# EasyEDA Pro project 智能视觉母版_2024.eprj, schematic Schematic1
Create Date: 2023-10-24; Page Name: P1; Project Name: 智能视觉母版_2024; Schematic Name: Schematic1; Update Date: 2023-11-27; Company: 嘉立创EDA; Page Size: A3; Version: V1.0
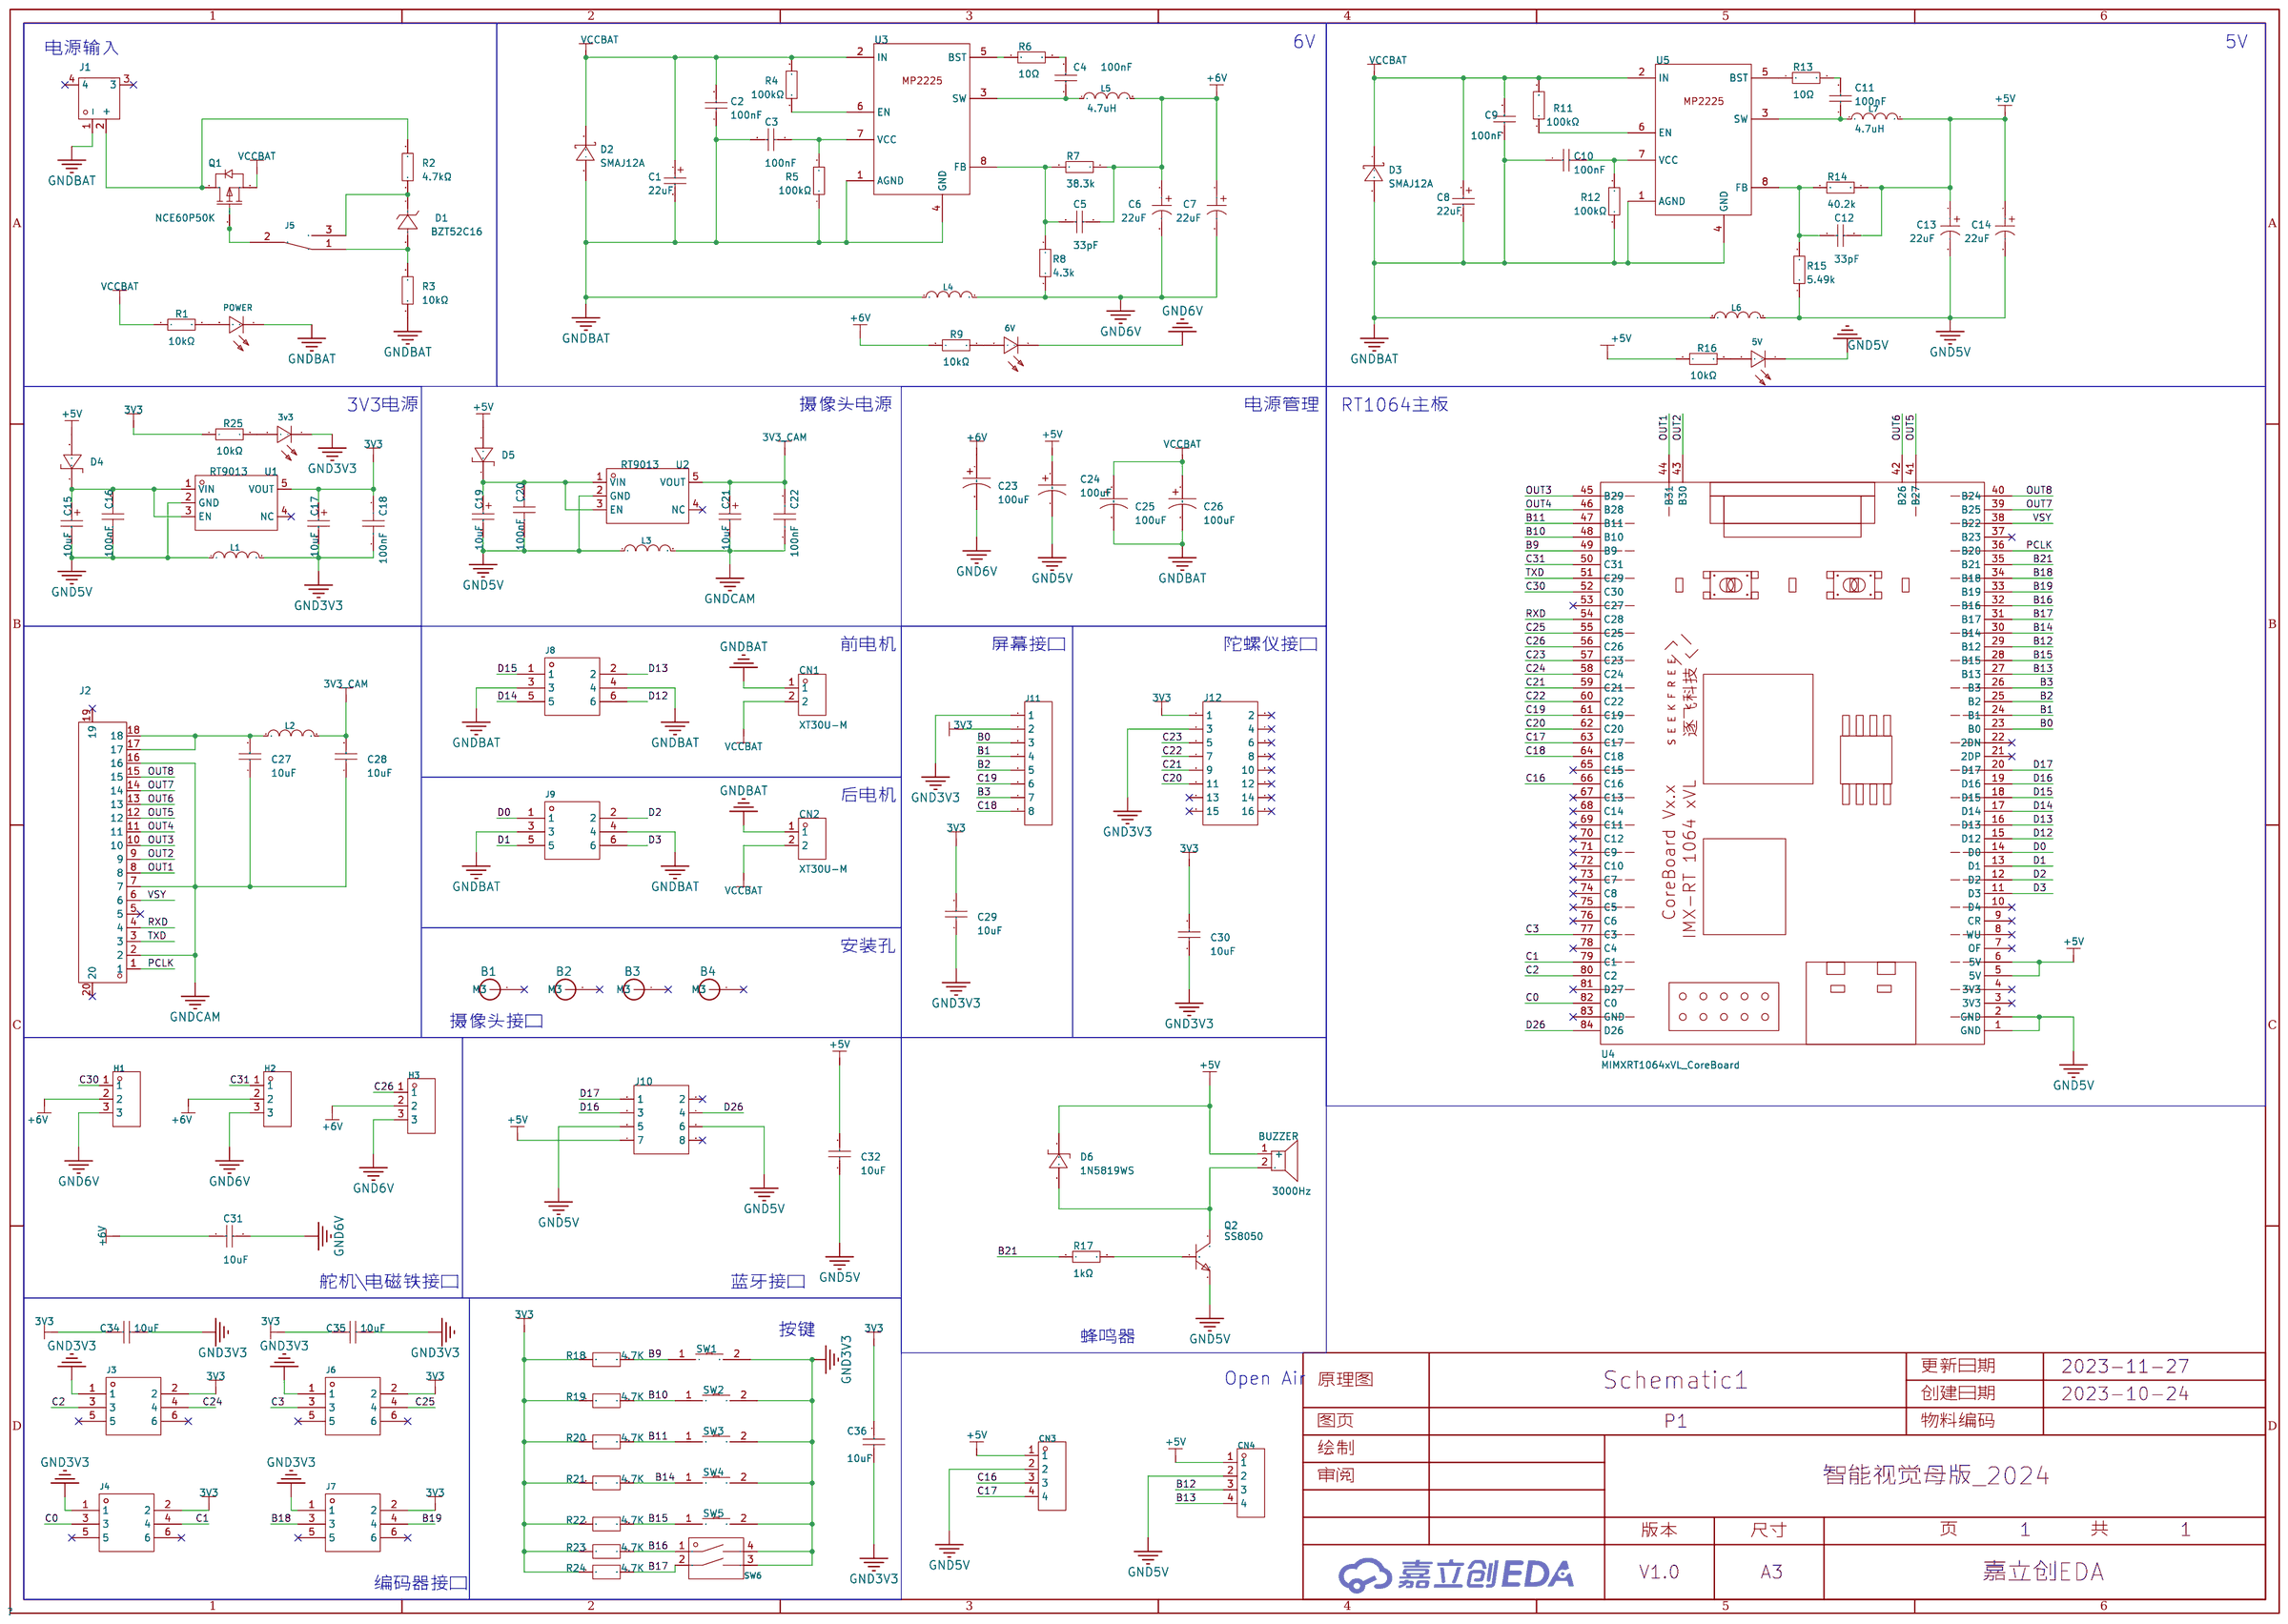
[diagram p0: schematic sheet]

## Parts
3v3  NCD0603W1  [LED0603-RD]
5V  NCD0603B1  [LED0603-RD]
6V  NCD0603W1  [LED0603-RD]
B1  M3螺柱孔_JX  [M3]
B2  M3螺柱孔_JX  [M3]
B3  M3螺柱孔_JX  [M3]
B4  M3螺柱孔_JX  [M3]
BUZZER  3000Hz  [BUZ-TH_BD9.6-P5.00-D0.7-FD]
C1  22uF  [CAP-SMD_L6.0-W3.2-R-RD]
C2  100nF  [C0603]
C3  100nF  [C0603]
C4  100nF  [C0603]
C5  33pF  [C0603]
C6  22uF  [CAP-SMD_L3.2-W1.6]
C7  22uF  [CAP-SMD_L3.2-W1.6]
C8  22uF  [CAP-SMD_L6.0-W3.2-R-RD]
C9  100nF  [C0603]
C10  100nF  [C0603]
C11  100nF  [C0603]
C12  33pF  [C0603]
C13  22uF  [CAP-SMD_L3.2-W1.6]
C14  22uF  [CAP-SMD_L3.2-W1.6]
C15  10uF  [CASE-A_3216]
C16  100nF  [C0603]
C17  10uF  [CASE-A_3216]
C18  100nF  [C0603]
C19  10uF  [CASE-A_3216]
C20  100nF  [C0603]
C21  10uF  [CASE-A_3216]
C22  100nF  [C0603]
C23  100uF  [CAP-TH_BD8.0-P3.50-D0.6-FD]
C24  100uF  [CAP-TH_BD8.0-P3.50-D0.6-FD]
C25  100uF  [CAP-TH_BD8.0-P3.50-D0.6-FD]
C26  100uF  [CAP-TH_BD8.0-P3.50-D0.6-FD]
C27  10uF  [C0805]
C28  10uF  [C0805]
C29  10uF  [C0805]
C30  10uF  [C0805]
C31  10uF  [C0805]
C32  10uF  [C0805]
C34  10uF  [C0805]
C35  10uF  [C0805]
C36  10uF  [C0805]
CN1  XT30U-M  [CONN-TH_XT30U-M]
CN2  XT30U-M  [CONN-TH_XT30U-M]
CN3  HC-XH-4A-G  [CONN-TH_4P-P2.50_HC-XH-4A-G]
CN4  HC-XH-4A-G  [CONN-TH_4P-P2.50_HC-XH-4A-G]
D1  BZT52C16  [SOD-123_L2.7-W1.6-LS3.7-RD]
D2  SMAJ12A  [SMA_L4.4-W2.7-LS5.1-RD]
D3  SMAJ12A  [SMA_L4.4-W2.7-LS5.1-RD]
D4  1N5819WS  [SOD-323_L1.8-W1.3-LS2.5-RD]
D5  1N5819WS  [SOD-323_L1.8-W1.3-LS2.5-RD]
D6  1N5819WS  [SOD-323_L1.8-W1.3-LS2.5-RD]
H1  -  [HDR-TH_3P-P2.54-V-F]
H2  -  [HDR-TH_3P-P2.54-V-F]
H3  -  [HDR-TH_3P-P2.54-V-F]
J1  XT60PW-M  [CONN-TH_XT60PW-M]
J2  0.5K-AX-18PWBG  [FPC-SMD_18P-P0.50_HDGC_0.5K-AX-18PWBG]
J3  75869-131LF  [CONN-TH_6P-P2.54_75869-131LF]
J4  75869-131LF  [CONN-TH_6P-P2.54_75869-131LF]
J5  MT-0-102-A101-M200-RS  [SW-TH_MT-0-103-A101-M200-RS]  (no BOM)
J6  75869-131LF  [CONN-TH_6P-P2.54_75869-131LF]
J7  75869-131LF  [CONN-TH_6P-P2.54_75869-131LF]
J8  75869-131LF  [CONN-TH_6P-P2.54_75869-131LF]
J9  75869-131LF  [CONN-TH_6P-P2.54_75869-131LF]
J10  -  [HDR-TH_8P-P2.54-V-F-R2-C4-S2.54-1]
J11  -  [HDR-TH_8P-P2.54-V-F-1]
J12  -  [HDR-TH_16P-P2.54-V-F-R2-C8-S2.54-1]
L1  CBG201209U000T  [L0805]
L2  CBG201209U000T  [L0805]
L3  CBG201209U000T  [L0805]
L4  CBG201209U000T  [L0805]
L5  4.7uH  [IND-SMD_L5.4-W5.2_FXL0530]
L6  CBG201209U000T  [L0805]
L7  4.7uH  [IND-SMD_L5.4-W5.2_FXL0530]
POWER  NCD0603R1  [LED0603-RD_RED]
Q1  NCE60P50K  [TO-252-2_L6.6-W6.1-P4.57-LS9.9-TL-CW]
Q2  SS8050  [SOT-23-3_L2.9-W1.3-P1.90-LS2.4-BR]
R1  10kΩ  [R0603]
R2  4.7kΩ  [R0603]
R3  10kΩ  [R0603]
R4  100kΩ  [R0603]
R5  100kΩ  [R0603]
R6  10Ω  [R0603]
R7  38.3k  [R0603]
R8  4.3k  [R0603]
R9  10kΩ  [R0603]
R11  100kΩ  [R0603]
R12  100kΩ  [R0603]
R13  10Ω  [R0603]
R14  40.2k  [R0603]
R15  5.49k  [R0603]
R16  10kΩ  [R0603]
R17  1kΩ  [R0603]
R18  4.7K  [R0603]
R19  4.7K  [R0603]
R20  4.7K  [R0603]
R21  4.7K  [R0603]
R22  4.7K  [R0603]
R23  4.7K  [R0603]
R24  4.7K  [R0603]
R25  10kΩ  [R0603]
SW1  TS-1101-C-W  [SW-SMD_L6.0-W3.3-LS8.0]
SW2  TS-1101-C-W  [SW-SMD_L6.0-W3.3-LS8.0]
SW3  TS-1101-C-W  [SW-SMD_L6.0-W3.3-LS8.0]
SW4  TS-1101-C-W  [SW-SMD_L6.0-W3.3-LS8.0]
SW5  TS-1101-C-W  [SW-SMD_L6.0-W3.3-LS8.0]
SW6  KF1001-02P-R0-FL-ON-01B  [SW-TH_KF1001-02P-R0-FL-ON-01B]
U1  RT9013  [SOT-23-5_L2.9-W1.6-P0.95-LS2.8-BR]
U2  RT9013  [SOT-23-5_L2.9-W1.6-P0.95-LS2.8-BR]
U3  -  [tsot-23-8_l2.9-w1.6-p0.65-ls2.8-br]
U4  MIMXRT1064xVL_CoreBoard  [MIMXRT1064xVL_CoreBoard - 3D]
U5  -  [tsot-23-8_l2.9-w1.6-p0.65-ls2.8-br]

## Library data of the parts
3v3 6V = NCD0603W1: 发光颜色:白灯;; LCSC Part Name: 白灯 0603白灯   正贴; Supplier Part: C84265; Manufacturer: 国星光电; Supplier Footprint: 0603; JLCPCB Part Class: Extended Part; Datasheet: https://atta.szlcsc.com/upload/public/pdf/source/20200820/C84265_479E6193713348A548E5CD6D9278BF16.pdf; Supplier: LCSC; Emitted Color: 白灯
5V = NCD0603B1: 发光颜色:蓝灯;; LCSC Part Name: 蓝灯; Supplier Part: C84266; Manufacturer: 国星光电; Supplier Footprint: 0603; JLCPCB Part Class: Extended Part; Datasheet: https://atta.szlcsc.com/upload/public/pdf/source/20200820/C84266_6A3CDBEFA72C6CAD68EDA53474ADAE6C.pdf; Supplier: LCSC; Emitted Color: 蓝灯
B1-B4 = M3螺柱孔_JX
BUZZER = HNB09A05: 驱动方式:有源(内含驱动线路);构造类型:电磁式;额定电压:5V;工作电压:4V~8V;频率:3000Hz;声压(SPL):85dB@5V,10cm;直径(φD):9mm;高度:5.7mm;; Supplier Part: C96493; Manufacturer: 华能; Supplier Footprint: 插件; JLCPCB Part Class: 扩展库; Datasheet: https://atta.szlcsc.com/upload/public/pdf/source/20170522/1495448327549.pdf; Supplier: LCSC; Oscillator Circuit: 有源(内含驱动线路); Technology Type: 电磁式; Rated Voltage: 5V; Operating Voltage: 4V~8V; Sound Pressure Level (SPL): 85dB@5V,10cm; Diameter (φD): 9mm; Height: 5.7mm
C1 C8 = TAJC226K025RNJ: 容值:22uF;精度:±10%;额定电压:25V;等效串联电阻:1.4Ω@100kHz;; LCSC Part Name: 22uF ±10% 25V; Supplier Part: C7214; Manufacturer: Kyocera AVX; Supplier Footprint: CASE-C-6032; JLCPCB Part Class: Extended Part; Datasheet: https://atta.szlcsc.com/upload/public/pdf/source/20160107/1457707749198.pdf; Supplier: LCSC; Tolerance: ±10%; Rated Voltage: 25V; Equivalent Series Resistance(ESR): 1.4Ω@100kHz; Operating Temperature: -55℃~+125℃
C2-C4 C9-C11 = 0603B104K500NT: 容值:100nF;精度:±10%;额定电压:50V;材质(温度系数):X7R;; LCSC Part Name: 100nF ±10% 50V; Supplier Part: C30926; Manufacturer: FH(风华); Supplier Footprint: 0603; JLCPCB Part Class: Extended Part; Datasheet: https://atta.szlcsc.com/upload/public/pdf/source/20170923/C30926_1506149436298988724.pdf; Supplier: LCSC; Tolerance: ±10%; Voltage Rated: 50V; Temperature Coefficient: X7R
C5 C12 = CL10C330JB8NNNC: 容值:33pF;精度:±5%;额定电压:50V;材质(温度系数):C0G;; LCSC Part Name: 33pF ±5% 50V; Supplier Part: C1663; Manufacturer: SAMSUNG(三星); Supplier Footprint: 0603; JLCPCB Part Class: 基础库; Datasheet: https://atta.szlcsc.com/upload/public/pdf/source/20160103/1457707688366.pdf; Supplier: LCSC; Tolerance: ±5%; Voltage Rated: 50V; Temperature Coefficient: C0G
C6 C7 C13 C14 = CA45-A-16V-22uF-K: 容值:22uF;精度:±10%;额定电压:16V;等效串联电阻:6Ω@100kHz;; LCSC Part Name: 22uF ±10% 16V; Supplier Part: C782264; Manufacturer: CEC(振华新云); Supplier Footprint: CASE-A-3216; JLCPCB Part Class: Extended Part; Datasheet: https://atta.szlcsc.com/upload/public/pdf/source/20200909/C782264_D6D9C4EF3B25E81633C26A9294FBB820.pdf; Supplier: LCSC; Tolerance: ±10%; Rated Voltage: 16V; Equivalent Series Resistance(ESR): 6Ω@100kHz; Operating Temperature: -55℃~+125℃
C15 C17 C19 C21 = CA45-A-10V-10uF-M: 容值:10uF;精度:±20%;额定电压:10V;等效串联电阻:8Ω@100kHz;工作温度:-55~+125;; LCSC Part Name: 10uF ±20% 10V; Supplier Part: C128256; Manufacturer: CEC(振华新云); JLCPCB Part Class: Extended Part; Datasheet: https://atta.szlcsc.com/upload/public/pdf/source/20171113/C128256_15105610660201115413.pdf; Supplier: LCSC; Tolerance: ±20%; Rated Voltage: 10V; Equivalent Series Resistance(ESR): 8Ω@100kHz; Operating Temperature: -55~+125
C16 C18 C20 C22 = CAP_0603: Supplier Footprint: 0603
C23-C26 = 25PZE220M8X9: 类型:混合物;容值:220uF;精度:±20%;额定电压:25V;电容体直径:8mm;电容体长度:9mm;脚间距:-;纹波电流:2.3A@100kHz;等效串联电阻:27mΩ@100kHz;工作寿命:10000hrs@105℃;工作温度:-55℃~+105℃;; LCSC Part Name: 220uF ±20% 25V; Supplier Part: C1578758; Manufacturer: rubycon(红宝石); Supplier Footprint: 径向引线,8x9mm; JLCPCB Part Class: Extended Part; Datasheet: https://atta.szlcsc.com/upload/public/pdf/source/20210510/C1578758_E2F1F56A0A42A1F170EC582F74BCA115.pdf; Supplier: LCSC; Type: 混合物; Tolerance: ±20%; Rated Voltage: 25V; φD: 8mm; L: 9mm; Ripple Current: 2.3A@100kHz; Equivalent Series Resistance(ESR): 27mΩ@100kHz; Lifetime @ Temp: 10000hrs@105℃; Operating Temperature: -55℃~+105℃
C27-C32 C34-C36 = CL21A106KAYNNNE_C15850: 容值:10uF;精度:±10%;额定电压:25V;材质(温度系数):X5R;; LCSC Part Name: 10uF ±10% 25V; Supplier Part: C15850; Manufacturer: SAMSUNG(三星); Manufacturer Part: CL21A106KAYNNNE; Supplier Footprint: 0805; JLCPCB Part Class: 基础库; Datasheet: https://atta.szlcsc.com/upload/public/pdf/source/20160103/1457707679302.pdf; Supplier: LCSC; Tolerance: ±10%; Voltage Rated: 25V; Temperature Coefficient: X5R
CN1 CN2 = XT30U-M: 模型插头轻量版锂电池插头; LCSC Part Name: AMASS(艾迈斯)轻量版锂电池插头公头 XT30U-M; Supplier Part: C99101; Manufacturer: AMASS(艾迈斯); JLCPCB Part Class: Extended Part; Datasheet: https://atta.szlcsc.com/upload/public/pdf/source/20170606/1496716542582.pdf; Supplier: LCSC
CN3 CN4 = HC-XH-4A-G: 参考系列:XH;间距:2.54mm;插针结构:1x4P;排数:1;每排PIN数:4;行距:2.54mm;公母:公型插针;安装方式:直插;额定电流:3A;工作温度范围:-25℃~+85℃;; LCSC Part Name: XH 2.54mm 1x4P 直插; Supplier Part: C5341203; Manufacturer: HCTL(华灿天禄); Supplier Footprint: 插件,P=2.5mm; JLCPCB Part Class: 扩展库; Datasheet: https://atta.szlcsc.com/upload/public/pdf/source/20230105/4FFD2EFD3DA44AA828171A44400F3EDE.pdf; Supplier: LCSC; Reference Series: XH; Pitch: 2.54mm; Pins Structure: 1x4P; Number of Rows: 1; Number of PINs Per Row: 4; Row Spacing: 2.54mm; Gender: 公型插针; Mounting Style: 直插; Current Rating (Max): 3A; Operating Temperature Range: -25℃~+85℃
D1 = BZT52C16: 稳压值(标称值):-;精度:-;功率:500mW;反向电流(Ir):100nA@11.2V;; LCSC Part Name: 500mW; Supplier Part: C707145; Manufacturer: Slkor(萨科微); Supplier Footprint: SOD-123; JLCPCB Part Class: 扩展库; Datasheet: https://atta.szlcsc.com/upload/public/pdf/source/20200721/C707125_BAEA70ACC1B0F60BBAC1FD71D8806D24.pdf; Supplier: LCSC; Power Dissipation: 500mW; Reverse Leakage Current (Ir): 100nA@11.2V
D2 D3 = SMAJ12A_C152123: 极性:单向;反向截止电压(Vrwm):12V;击穿电压:13.3V;峰值脉冲电流(Ipp)@10/1000μs:20.1A;最大钳位电压:19.9V;; LCSC Part Name: 单向 Vrwm:12V; Supplier Part: C152123; Manufacturer: BORN(伯恩半导体); Supplier Footprint: SMA(DO-214AC); JLCPCB Part Class: 扩展库; Datasheet: https://atta.szlcsc.com/upload/public/pdf/source/20181205/C152123_F062F647BF686681D55A64EEC7CBEC59.pdf; Supplier: LCSC; Polarity: 单向; Reverse Stand-Off Voltage (Vrwm): 12V; Breakdown Voltage: 13.3V; Peak Pulse Current (Ipp)@10/1000μs: 20.1A; Maximum Clamping Voltage: 19.9V
D4-D6 = 1N5819WS_C191023: 直流反向耐压(Vr):40V;平均整流电流(Io):1A;正向压降(Vf):600mV@1A;; LCSC Part Name: 40V 1A 600mV@1A; Supplier Part: C191023; Manufacturer: Hottech(合科泰); Supplier Footprint: SOD-323; JLCPCB Part Class: 基础库; Datasheet: https://atta.szlcsc.com/upload/public/pdf/source/20220428/3CB86FD8D28D653594B4E35F9D5AEFD9.pdf; Supplier: LCSC; Reverse Voltage (Vr): 40V; Average Rectified Current (Io): 1A; Forward Voltage (Vf@If): 600mV@1A
H1-H3 = HDR-F_2.54_1x3P: Supplier Part: C541850; Supplier Footprint: 插件
J1 = XT60PW-M: 模型锂电连接器; LCSC Part Name: AMASS(艾迈斯)航模插头xt90连接器150公母对接pw锂电池公头 板插卧式XT60PW-M; Supplier Part: C98732; Manufacturer: AMASS(艾迈斯); JLCPCB Part Class: 扩展库; Datasheet: https://atta.szlcsc.com/upload/public/pdf/source/20180125/C98732_15168617837851301983.pdf; Supplier: LCSC
J2 = 0.5K-AX-18PWBG: 间距:0.5mm;触点数量:18;锁定特性:抽屉式;安装类型:卧贴;触点类型:下接;工作温度范围:-20℃~+85℃;; LCSC Part Name: 0.5mm P数:18 抽屉式 下接; Supplier Part: C2911979; Manufacturer: HDGC(华德共创); Supplier Footprint: SMD,P=0.5mm; JLCPCB Part Class: 扩展库; Datasheet: https://atta.szlcsc.com/upload/public/pdf/source/20211029/35E053C67D57850EB47D55B58FB5F508.pdf; Supplier: LCSC; Pitch: 0.5mm; Number of Contacts: 18; Locking Feature: 抽屉式; Mounting Type: 卧贴; Contact Type: 下接; Height Above Board: 2mm; FFC, FCB Thickness: 0.3mm; Operating Temperature Range: -20℃~+85℃
J3 J4 J6-J9 = 75869-131LF: 参考系列:-;间距:2.54mm;插针结构:2x3P;排数:2;每排PIN数:3;行距:2.54mm;安装方式:-;触头材质:磷青铜;; LCSC Part Name: 2.54mm 2x3P; Supplier Part: C168680; Manufacturer: Amphenol; Supplier Footprint: 插件,P=2.54mm; JLCPCB Part Class: 扩展库; Supplier: LCSC; Pitch: 2.54mm; Pins Structure: 2x3P; Number of Rows: 2; Number of PINs Per Row: 3; Row Spacing: 2.54mm; Contact Material: 磷青铜
J5 = MT-0-102-A101-M200-RS: 额定电流:5A;额定电压(AC):125V;电路结构:单刀双掷;机械寿命:-;安装方式:直插;; LCSC Part Name: 小型钮子三脚二档 二件套 含配件; Supplier Part: C1788492; Manufacturer: YUEN FUNG(源丰); Supplier Footprint: 插件; JLCPCB Part Class: 扩展库; Datasheet: https://atta.szlcsc.com/upload/public/pdf/source/20230720/8E5C36EFDF374AE4FF4AC09DB233CE0E.pdf; Supplier: LCSC; Contact Current: 5A; Voltage Rating (AC): 125V; Circuit: 单刀双掷; Actuator Type: 圆柱钮柄; Pin Style: 焊片; Mounting Style: 直插; Operating Temperature: -25℃~+85℃; Switch Length: 13mm; Switch Width: 8mm; Switch Height: 28.6mm
J10 = HDR-F_2.54_2x4: Supplier Part: C92271; Supplier Footprint: 插件
J11 = HDR-F_2.54_1x8P: Supplier Part: C27438; Supplier Footprint: 插件
J12 = HDR-F_2.54_2x8: Supplier Part: C30734; Supplier Footprint: 插件
L1-L4 L6 = CBG201209U000T: 标称阻抗@测试频率:0Ω@100MHz;直流电阻(RDC):80mΩ;; LCSC Part Name: 单路 0805磁珠 阻抗0Ω@100MHz; Supplier Part: C91037; Manufacturer: FH(风华); Supplier Footprint: 0805; JLCPCB Part Class: 扩展库; Datasheet: https://atta.szlcsc.com/upload/public/pdf/source/20161217/1481939213023.pdf; Supplier: LCSC; Impedance @ Frequency: 0Ω@100MHz; DC Resistance: 80mΩ; Current Rating: 900mA; Circuits: 1
L5 L7 = FXL0530-4R7-M: 电感值:4.7uH;精度:±20%;额定电流:4.5A;饱和电流(Isat):5A;; LCSC Part Name: 4.7uH ±20% 4.5A 50mΩ; Supplier Part: C177246; Manufacturer: cjiang(长江微电); Supplier Footprint: SMD,5.4x5.2x2.8mm; JLCPCB Part Class: Extended Part; Supplier: LCSC; Tolerance: ±20%; Rated Current: 4.5A; Saturation Current (Isat): 5A; DC Resistance (DCR): 50mΩ
POWER = NCD0603R1_C84263: 发光颜色:红灯;; LCSC Part Name: 红灯 0603红灯   正贴; Supplier Part: C84263; Manufacturer: 国星光电; Supplier Footprint: 0603; JLCPCB Part Class: Extended Part; Datasheet: https://atta.szlcsc.com/upload/public/pdf/source/20200820/C84263_DABC6A75E58F576973B407FDBA283D60.pdf; Supplier: LCSC; Emitted Color: 红灯
Q1 = NCE60P50K: 类型:P沟道;漏源电压(Vdss):60V;连续漏极电流(Id):50A;功率(Pd):95W;导通电阻(RDS(on)@Vgs,Id):23mΩ@10V,20A;阈值电压(Vgs(th)@Id):3.5V@250uA;; LCSC Part Name: P沟道 60V 50A; Supplier Part: C130104; Manufacturer: NCE(无锡新洁能); Supplier Footprint: TO-252-2(DPAK); JLCPCB Part Class: 扩展库; Datasheet: https://atta.szlcsc.com/upload/public/pdf/source/20170919/C130104_1505787180031976877.pdf; Supplier: LCSC; Type: P沟道; Drain Source Voltage (Vdss): 60V; Continuous Drain Current (Id): 50A; Power Dissipation (Pd): 95W; Drain Source On Resistance (RDS(on)@Vgs,Id): 23mΩ@10V,20A; Gate Threshold Voltage (Vgs(th)@Id): 3.5V@250uA
Q2 = SS8050_C2150: 晶体管类型:NPN;集射极击穿电压(Vceo):25V;集电极电流(Ic):1.5A;功率(Pd):300mW;直流电流增益(hFE@Ic,Vce):200@100mA,1V;; LCSC Part Name: NPN 25V 1.5A Y1 200-350; Supplier Part: C2150; Manufacturer: CJ(江苏长电/长晶); Supplier Footprint: SOT-23; JLCPCB Part Class: 基础库; Datasheet: https://atta.szlcsc.com/upload/public/pdf/source/20230322/AEE86F4B043774EFF80CAEA14A37D9E9.pdf; Supplier: LCSC; Transistor Type: NPN; Collector-Emitter Breakdown Voltage (Vceo): 25V; Collector Current (Ic): 1.5A; Power Dissipation (Pd): 300mW; Collector Cut-Off Current (Icbo): 100nA; Collector-Emitter Saturation Voltage (VCE(sat)@Ic,Ib): 500mV@800mA,80mA; DC Current Gain (hFE@Ic,Vce): 200@100mA,1V; Transition Frequency (fT): 100MHz; Operating Temperature: +150℃@(Tj)
R1 R3 R9 R16 R25 = 0603WAF1002T5E: 电阻类型:厚膜电阻;阻值:10kΩ;精度:±1%;功率:100mW;; LCSC Part Name: 厚膜电阻 10kΩ ±1% 100mW; Supplier Part: C25804; Manufacturer: UNI-ROYAL(厚声); Supplier Footprint: 0603; JLCPCB Part Class: 基础库; Datasheet: https://atta.szlcsc.com/upload/public/pdf/source/20200306/C422600_1E6D84923E4A46A82E41ADD87F860B5C.pdf; Supplier: LCSC; Type: 厚膜电阻; Tolerance: ±1%; Power(Watts): 100mW; Temperature Coefficient: ±100ppm/℃; Overload Voltage (Max): 75V; Operating Temperature Range: -55℃~+155℃
R2 = 0603WAF4701T5E: 电阻类型:厚膜电阻;阻值:4.7kΩ;精度:±1%;功率:100mW;; LCSC Part Name: 4.7kΩ ±1% 100mW; Supplier Part: C23162; Manufacturer: UNI-ROYAL(厚声); Supplier Footprint: 0603; JLCPCB Part Class: Basic Part; Datasheet: https://atta.szlcsc.com/upload/public/pdf/source/20200306/C422600_1E6D84923E4A46A82E41ADD87F860B5C.pdf; Supplier: LCSC; Type: 厚膜电阻; Tolerance: ±1%; Power(Watts): 100mW; Temperature Coefficient: ±100ppm/℃; Overload Voltage (Max): 75V; Operating Temperature Range: -55℃~+155℃
R4 R5 R11 R12 = RC0603FR-07100KL: 电阻类型:厚膜电阻;阻值:100kΩ;精度:±1%;功率:100mW;; LCSC Part Name: 100kΩ ±1% 100mW; Supplier Part: C14675; Manufacturer: YAGEO(国巨); Supplier Footprint: 0603; JLCPCB Part Class: Extended Part; Datasheet: https://atta.szlcsc.com/upload/public/pdf/source/20140324/1457707028752.pdf; Supplier: LCSC; Type: 厚膜电阻; Tolerance: ±1%; Power(Watts): 100mW; Temperature Coefficient: ±100ppm/℃; Overload Voltage (Max): 75V; Operating Temperature Range: -55℃~+155℃
R6 R13 = 0603WAF100JT5E: 电阻类型:厚膜电阻;阻值:10Ω;精度:±1%;功率:100mW;; LCSC Part Name: 10Ω ±1% 100mW; Supplier Part: C22859; Manufacturer: UNI-ROYAL(厚声); Supplier Footprint: 0603; JLCPCB Part Class: Basic Part; Datasheet: https://atta.szlcsc.com/upload/public/pdf/source/20200306/C422600_1E6D84923E4A46A82E41ADD87F860B5C.pdf; Supplier: LCSC; Type: 厚膜电阻; Tolerance: ±1%; Power(Watts): 100mW; Temperature Coefficient: ±400ppm/℃; Overload Voltage (Max): 75V; Operating Temperature Range: -55℃~+155℃
R7 R14 = 0603WAF4022T5E: 电阻类型:厚膜电阻;阻值:40.2kΩ;精度:±1%;功率:100mW;; LCSC Part Name: 40.2kΩ ±1% 100mW; Supplier Part: C12447; Manufacturer: UNI-ROYAL(厚声); Supplier Footprint: 0603; JLCPCB Part Class: Basic Part; Datasheet: https://atta.szlcsc.com/upload/public/pdf/source/20200306/C422600_1E6D84923E4A46A82E41ADD87F860B5C.pdf; Supplier: LCSC; Type: 厚膜电阻; Tolerance: ±1%; Power(Watts): 100mW; Temperature Coefficient: ±100ppm/℃; Overload Voltage (Max): 75V; Operating Temperature Range: -55℃~+155℃
R8 R15 = 0603WAF5491T5E: 电阻类型:厚膜电阻;阻值:5.49kΩ;精度:±1%;功率:100mW;; LCSC Part Name: 5.49kΩ ±1% 100mW; Supplier Part: C23069; Manufacturer: UNI-ROYAL(厚声); Supplier Footprint: 0603; JLCPCB Part Class: Extended Part; Datasheet: https://atta.szlcsc.com/upload/public/pdf/source/20200306/C422600_1E6D84923E4A46A82E41ADD87F860B5C.pdf; Supplier: LCSC; Type: 厚膜电阻; Tolerance: ±1%; Power(Watts): 100mW; Temperature Coefficient: ±100ppm/℃; Overload Voltage (Max): 75V; Operating Temperature Range: -55℃~+155℃
R17 = 0603WAF1001T5E: 电阻类型:厚膜电阻;阻值:1kΩ;精度:±1%;功率:100mW;; LCSC Part Name: 1kΩ ±1% 100mW; Supplier Part: C21190; Manufacturer: UNI-ROYAL(厚声); Supplier Footprint: 0603; JLCPCB Part Class: Basic Part; Datasheet: https://atta.szlcsc.com/upload/public/pdf/source/20200306/C422600_1E6D84923E4A46A82E41ADD87F860B5C.pdf; Supplier: LCSC; Type: 厚膜电阻; Tolerance: ±1%; Power(Watts): 100mW; Temperature Coefficient: ±100ppm/℃; Overload Voltage (Max): 75V; Operating Temperature Range: -55℃~+155℃
R18-R24 = 0603: Supplier Part: C9900021181; JLCPCB Part Class: 扩展库; Datasheet: https://atta.szlcsc.comnull; Supplier: LCSC
SW1-SW5 = TS-1101-C-W: 触点电流:50mA;额定电压(AC):-;额定电压(DC):12V;额定功率:-;绝缘电阻:-;电路结构:单刀单掷;安装方式:立贴;带灯:无;作用力:260gf;机械寿命:5万次;带支架:否;; LCSC Part Name: 立贴 6*3.6*2.5mm 轻触开关 一型3*6*2.5有白ZD b拉伸白色带淡绿按键 卷装; Supplier Part: C318938; Manufacturer: XKB Connectivity(中国星坤); Supplier Footprint: SMD; JLCPCB Part Class: 扩展库; Datasheet: https://atta.szlcsc.com/upload/public/pdf/source/20200227/C318938_C2E53B1EEDE37D980A33616AC086DE53.pdf; Supplier: LCSC; Contact Current: 50mA; Voltage Rating (DC): 12V; Circuit: 单刀单掷; Mounting Style: 立贴; Actuator Style: 矩形按钮; Actuator/Cap Color: 白色带淡绿; With Lamp: 无; Operating Force: 260gf; Mechanical Life: 5万次; Operating Temperature: -30℃~+85℃; Switch Length: 6mm; Switch Width: 3.6mm; Switch Height: 2.5mm; Strike Gundam: 否
SW6 = KF1001-02P-R0-FL-ON-01B: 拨码开关 平拨，凸起式 单刀单掷  2  2.54mm; LCSC Part Name: 间距2.54mm 平拨,凸起式 2位拨码开关; Supplier Part: C976324; Manufacturer: 凯峰; Supplier Footprint: 插件; JLCPCB Part Class: Extended Part; Datasheet: https://atta.szlcsc.com/upload/public/pdf/source/20201229/C976324_7B1CB18A800AB7399198E0C73F3ACFC5.pdf; Supplier: LCSC
U1 U2 = RT9013-30GB: LCSC Part Name: CMOS LDO Regulator; Supplier Part: C3031664; Manufacturer: RICHTEK(台湾立锜); Supplier Footprint: SOT-23-5; Datasheet: https://atta.szlcsc.com/upload/public/pdf/source/20151126/1457707591671.pdf; Supplier: LCSC
U3 U5 = MP2225: DC-DC芯片
U4 = MIMXRT1064xVL_CoreBoard

## Nets
3V3: C17.1 C18.2 C29.2 C30.2 C34.2 C35.2 C36.2 J3.2 J4.2 J6.2 J7.2 J11.2 J12.1 R18.2 R19.2 R20.2 R21.2 R22.2 R23.2 R24.2 R25.1 U1.5(VOUT)
3V3_CAM: C21.1 C22.2 C28.2 L2.2 U2.5(VOUT)
+5V: BUZZER.1(+) C12.1 C13.1 C14.1 C24.1 C32.2 CN3.1 CN4.1 D4.2(A) D5.2(A) D6.1(C) J10.7 L7.2 R14.1 R16.1 U4.5(5V) U4.6(5V)
+6V: C5.1 C6.1 C7.1 C23.1 C31.2 H1.2 H2.2 H3.2 L5.2 R7.1 R9.1
GND3V3: 3v3.1(-) C17.2 C18.1 C29.1 C30.1 C34.1 C35.1 C36.1 J3.1 J4.1 J6.1 J7.1 J11.1 J12.3 L1.2 SW1.2 SW2.2 SW3.2 SW4.2 SW5.2 SW6.3 SW6.4
GND5V: 5V.1(-) C13.2 C14.2 C15.2 C16.1 C19.2 C20.1 C24.2 C32.1 CN3.2 CN4.2 J10.5 J10.6 L1.1 L3.1 L6.2 Q2.2(E) R15.1 U1.2(GND) U2.2(GND) U4.1(GND) U4.2(GND)
GND6V: 6V.1(-) C6.2 C7.2 C23.2 C31.1 H1.3 H2.3 H3.3 L4.2 R8.1
GNDBAT: C1.2 C2.1 C3.2 C8.2 C9.1 C10.1 C25.2 C26.2 CN1.1 CN2.1 D2.2(A) D3.2(A) J1.1(-) J8.3 J8.4 J9.3 J9.4 L4.1 L6.1 POWER.1(K) R3.2 R5.1 R12.1 U3.1(AGND) U3.4(GND) U5.1(AGND) U5.4(GND)
GNDCAM: C21.2 C22.1 C27.1 C28.1 J2.2 J2.7 J2.16 L3.2
VCCBAT: C1.1 C2.2 C8.1 C9.2 C25.1 C26.1 CN1.2 CN2.2 D2.1(K) D3.1(K) Q1.2(D) R1.1 R4.2 R11.2 U3.2(IN) U5.2(IN)
B0: J11.3 U4.23(B0)
B1: J11.4 U4.24(B1)
B2: J11.5 U4.25(B2)
B3: J11.7 U4.26(B3)
B9: R18.1 SW1.1 U4.49(B9)
B10: R19.1 SW2.1 U4.48(B10)
B11: R20.1 SW3.1 U4.47(B11)
B12: CN4.3 U4.29(B12)
B13: CN4.4 U4.27(B13)
B14: R21.1 SW4.1 U4.30(B14)
B15: R22.1 SW5.1 U4.28(B15)
B16: R23.1 SW6.1 U4.32(B16)
B17: R24.1 SW6.2 U4.31(B17)
B18: J7.3 U4.34(B18)
B19: J7.4 U4.33(B19)
B21: R17.1 U4.35(B21)
C0: J4.3 U4.82(C0)
C1: J4.4 U4.79(C1)
C2: J3.3 U4.80(C2)
C3: J6.3 U4.77(C3)
C16: CN3.3 U4.66(C16)
C17: CN3.4 U4.63(C17)
C18: J11.8 U4.64(C18)
C19: J11.6 U4.61(C19)
C20: J12.11 U4.62(C20)
C21: J12.9 U4.59(C21)
C22: J12.7 U4.60(C22)
C23: J12.5 U4.57(C23)
C24: J3.4 U4.58(C24)
C25: J6.4 U4.55(C25)
C26: H3.1 U4.56(C26)
C30: H1.1 U4.52(C30)
C31: H2.1 U4.50(C31)
D0: J9.1 U4.14(D0)
D1: J9.5 U4.13(D1)
D2: J9.2 U4.12(D2)
D3: J9.6 U4.11(D3)
D12: J8.6 U4.15(D12)
D13: J8.2 U4.16(D13)
D14: J8.5 U4.17(D14)
D15: J8.1 U4.18(D15)
D16: J10.3 U4.19(D16)
D17: J10.1 U4.20(D17)
D26: J10.4 U4.84(D26)
OUT1: J2.8 U4.44(B31)
OUT2: J2.9 U4.43(B30)
OUT3: J2.10 U4.45(B29)
OUT4: J2.11 U4.46(B28)
OUT5: J2.12 U4.41(B27)
OUT6: J2.13 U4.42(B26)
OUT7: J2.14 U4.39(B25)
OUT8: J2.15 U4.40(B24)
PCLK: J2.1 U4.36(B20)
RXD: J2.4 U4.54(C28)
TXD: J2.3 U4.51(C29)
VSY: J2.6 U4.38(B22)
$1N2017: D1.1(K) J5.3 R2.1
$1N2018: D1.2(A) J5.1 R3.1
$1N2019: J1.2(+) Q1.3(S) R2.2
$1N2020: J5.2 Q1.1(G)
$1N2023: POWER.2(A) R1.2
$1N2720: R11.1 U5.6(EN)
$1N2721: C11.1 L7.1 U5.3(SW)
$1N2725: 5V.2(+) R16.2
$1N2726: C10.2 R12.2 U5.7(VCC)
$1N2727: R13.1 U5.5(BST)
$1N2728: C11.2 R13.2
$1N2730: C12.2 R14.2 R15.2 U5.8(FB)
$1N3433: C4.1 L5.1 U3.3(SW)
$1N3437: 6V.2(+) R9.2
$1N3439: R4.1 U3.6(EN)
$1N3441: C3.1 R5.2 U3.7(VCC)
$1N3443: C5.2 R7.2 R8.2 U3.8(FB)
$1N3444: C4.2 R6.2
$1N3445: R6.1 U3.5(BST)
$1N3714: C19.1 C20.2 D5.1(C) U2.1(VIN) U2.3(EN)
$1N5546: C15.1 C16.2 D4.1(C) U1.1(VIN) U1.3(EN)
$1N5812: C27.2 J2.17 J2.18 L2.1
$1N7643: BUZZER.2 D6.2(A) Q2.3(C)
$1N7645: Q2.1(B) R17.2
$1N9389: 3v3.2(+) R25.2

Not connected (* = marked no-connect by the designer): B1 1(M3)*; B2 1(M3)*; B3 1(M3)*; B4 1(M3)*; J1 3* 4*; J2 5* 19* 20*; J3 5* 6*; J4 5* 6*; J6 5* 6*; J7 5* 6*; J10 2* 8*; J12 2* 4* 6* 8* 10* 12* 13* 14* 15* 16*; U1 4(NC)*; U2 4(NC)*; U4 3(3V3)* 4(3V3)* 7(OF)* 8(WU)* 9(CR)* 10(D4)* 21(2DP)* 22(2DN)* 37(B23)* 53(C27)* 65(C15)* 67(C13)* 68(C14)* 69(C11)* 70(C12)* 71(C9)* 72(C10)* 73(C7)* 74(C8)* 75(C5)* 76(C6)* 78(C4)* 81(D27)* 83(GND)*

## Notes on the sheet
- 电源输入
- 6V
- 5V
- 3V3电源
- 摄像头电源
- 电源管理
- RT1064主板
- 前电机
- 屏幕接口
- 陀螺仪接口
- 后电机
- 安装孔
- 摄像头接口
- 舵机\电磁铁接口
- 蓝牙接口
- 按键
- 蜂鸣器
- Open Air
- 编码器接口
